# EasyEDA Pro project ProPrj_Avaota A1 八核 AIoT 开发板_2024-05-03.epro, board 点位_BOTTOM (continued)
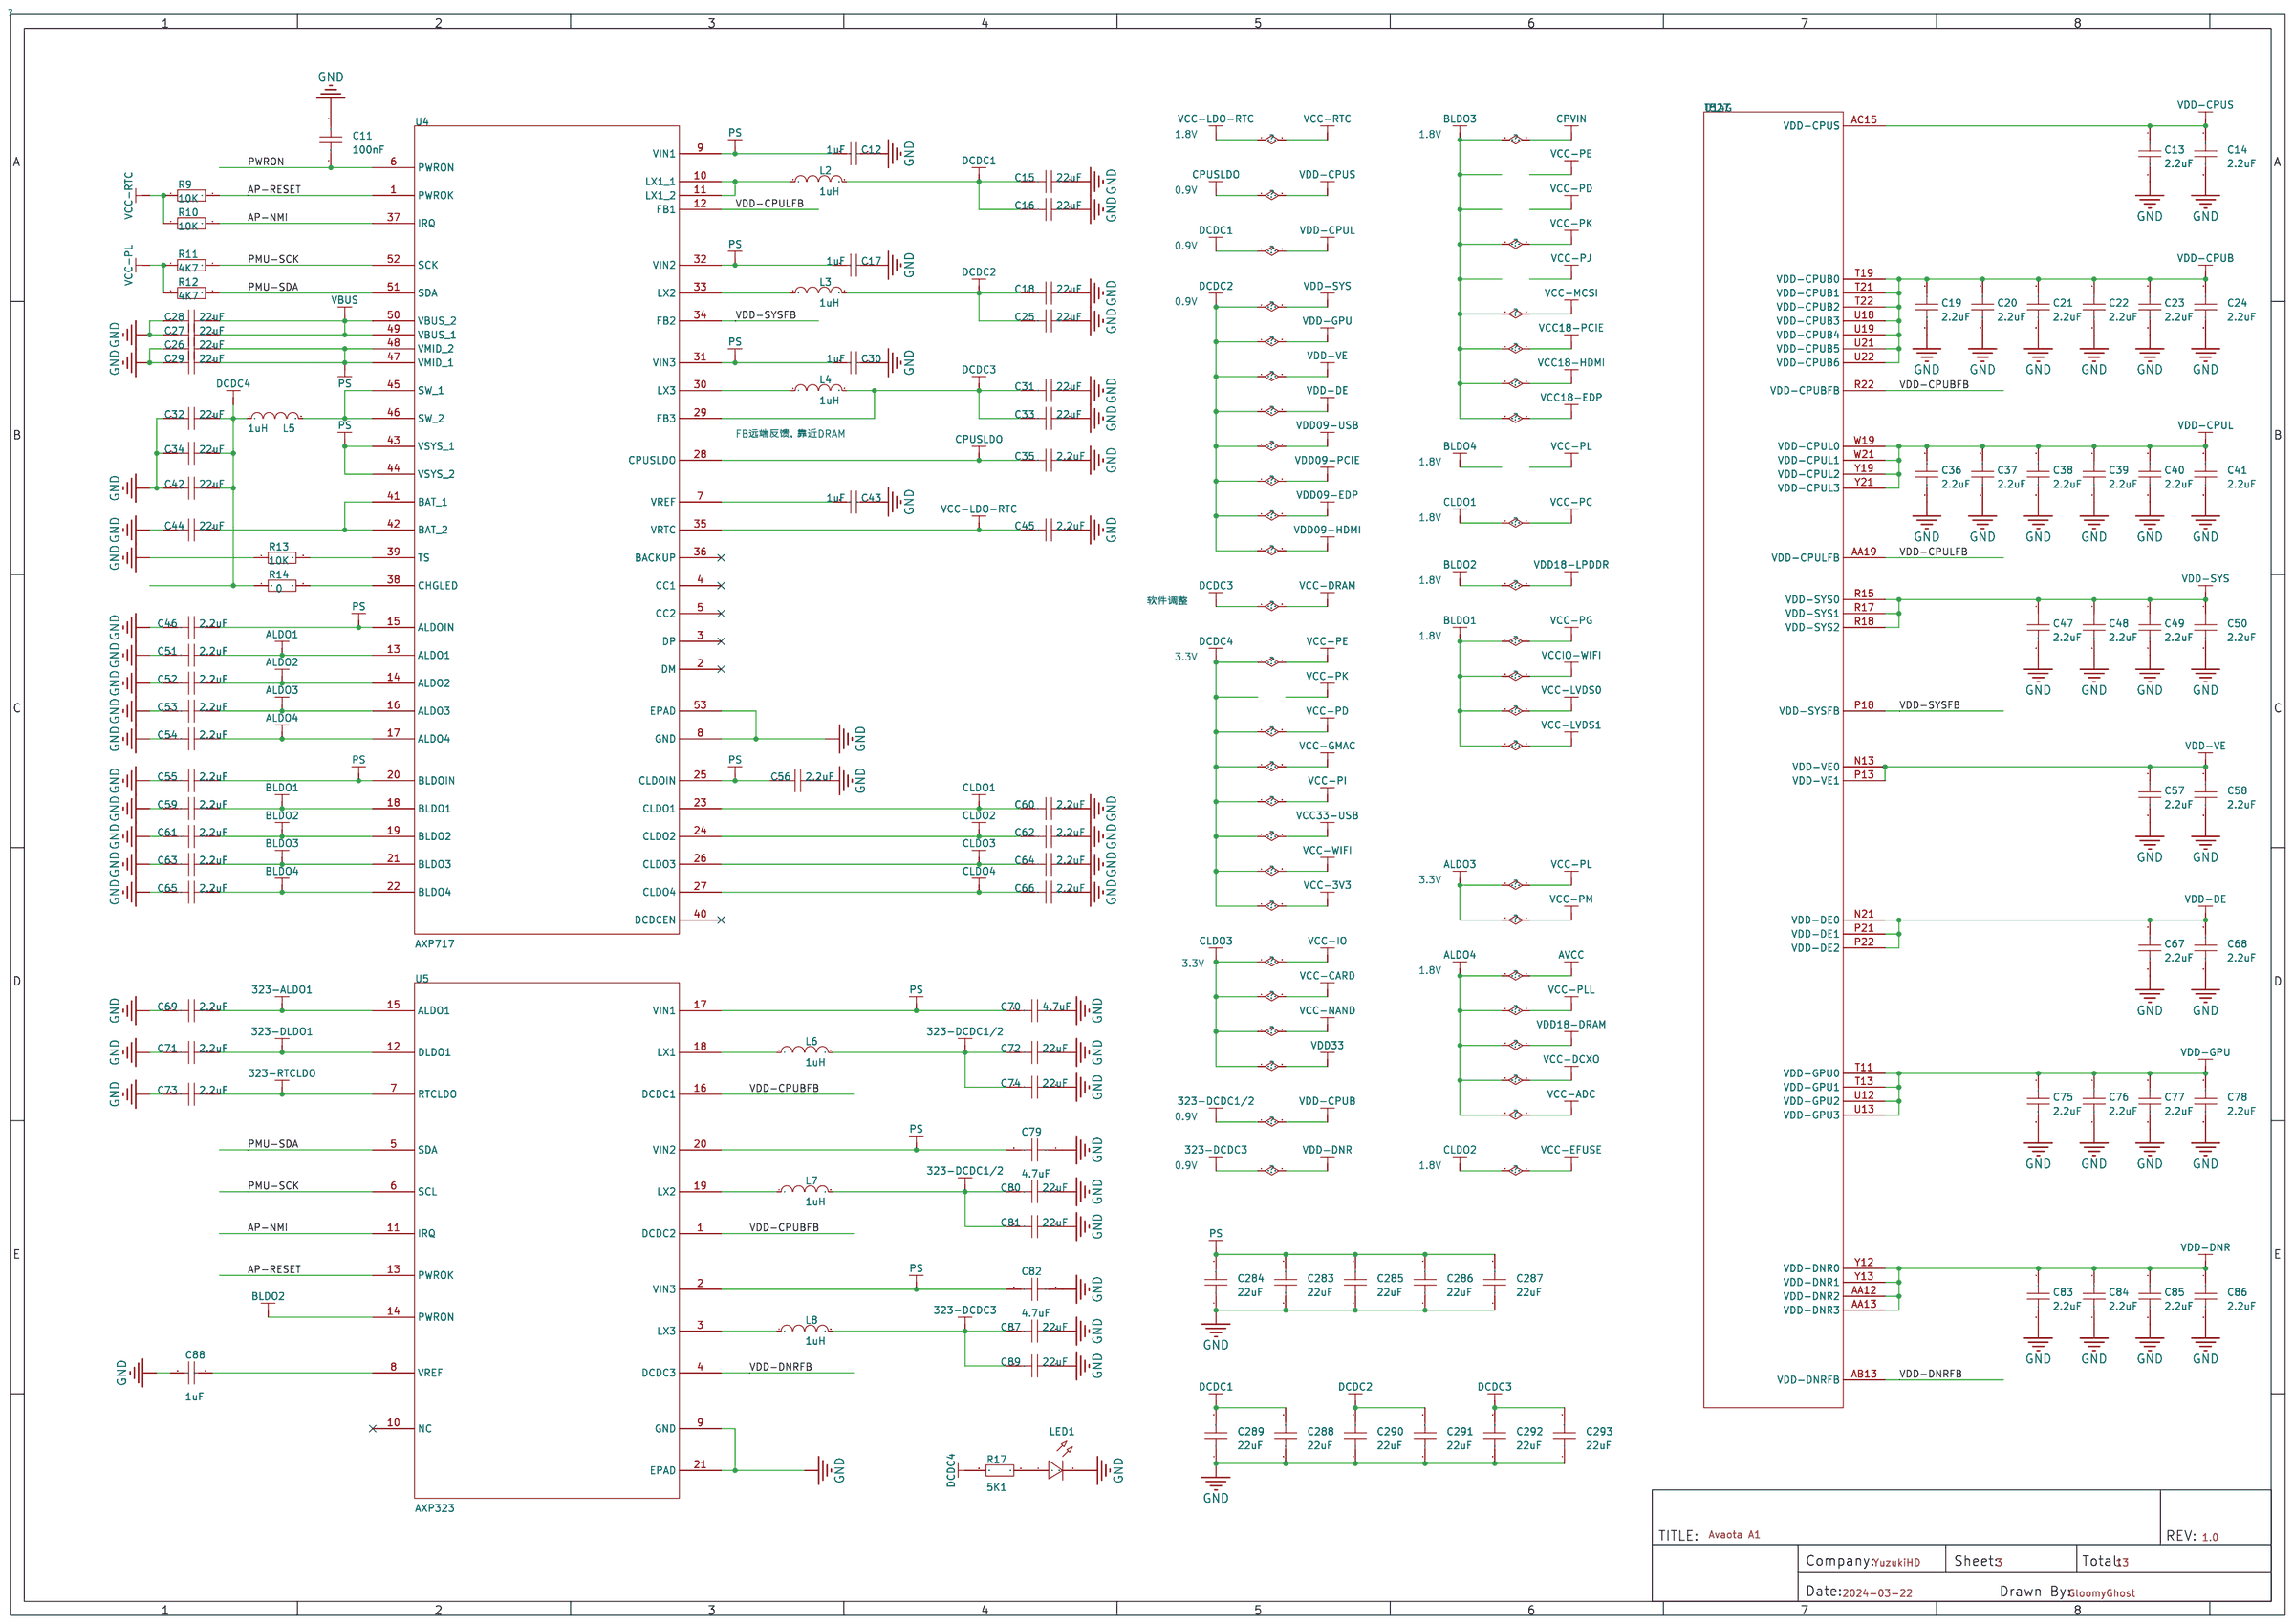
[diagram p0: POWER]
## Routing (per net, layer and track width the routed paths; a pad name or vN(x,y) marks a point on that pad's centre or on a via; arc(x,y) is an arc through that point) (continued)
SDQ22: length 9.9
  内层2 w0.115: v3(45.82,52.55) 45.43,52.16 45.43,51.31 49.66,47.08 49.94,47.08 51.38,45.63 v3(51.38,45.47)
SDQ23: length 17.3
  内层2 w0.115: v3(42.82,54.46) 45.72,54.46 51.59,48.59 51.97,48.59 54.4,46.15 56.12,46.15 v3(56.55,45.72)
SDQ24: length 24.8
  Inner5 w0.115: v3(56.54,46.68) 56.54,46.89 55.78,47.65 55.23,47.65 54.51,48.37 54.51,48.39 54.2,48.69 51.51,48.69 49.38,50.83 49.38,50.99 45.37,54.99 37.41,54.99 36.88,54.46 36.88,54.05 36.6,53.77 36.24,53.77 v3(36.17,53.7)
SDQ25: length 22
  Inner5 w0.115: v3(37.69,54.61) 38.07,54.23 38.81,54.23 39.04,54.46 40.36,54.46 40.73,54.09 45.68,54.09 48.96,50.81 48.96,50.58 51.13,48.41 53.87,48.41 55.01,47.27 55.52,47.27 56.01,46.79 v3(56.01,46.68)
SDQ26: length 26
  Inner5 w0.115: v3(34.57,51.71) 34.21,52.07 34.21,53.19 34.44,53.42 35.05,53.42 35.18,53.29 36.58,53.29 36.96,53.67 37.79,53.67 38.02,53.9 38.96,53.9 39.09,54.03 40.31,54.03 40.66,53.67 45.39,53.67 48.54,50.52 48.54,50.41 50.84,48.11 53.59,48.11 54.96,46.73 v3(54.96,46.68)
SDQ27: length 23.4
  Inner5 w0.115: v3(54.43,46.68) 53.77,47.35 51.01,47.35 46.95,51.41 46.56,51.41 46.3,51.66 46.3,51.79 46,52.1 45.62,52.1 44.49,53.23 41.95,53.23 41.81,53.37 40.46,53.37 40.1,53.72 39.22,53.72 39.11,53.62 38.07,53.62 37.82,53.37 37.54,53.37 37.41,53.24 37.41,52.98 37.26,52.83 34.77,52.83 v3(34.59,53.01)
SDQ28: length 11.9
  Inner5 w0.115: v3(37.64,50.75) 37.64,50.41 37.75,50.29 38.83,50.29 39.16,49.96 39.62,49.96 39.88,50.22 40.49,50.22 40.69,50.01 41.48,50.01 41.55,49.94 42.03,49.94 42.54,49.43 43.12,49.43 43.47,49.07 43.86,49.07 44.09,49.3 44.39,49.3 44.99,48.7 46.09,48.7 46.63,48.16 46.63,47.82 47.26,47.2 v3(47.27,47.2)
SDQ29: length 24
  Inner5 w0.115: v3(54.43,45.68) 53.96,45.68 53.76,45.88 52.59,45.88 52.18,46.29 48.19,46.29 47.78,46.71 47.14,46.71 45.57,48.29 44.3,48.29 43.93,48.65 43.3,48.65 42.95,49.01 42.45,49.01 41.91,49.56 41.43,49.56 41.25,49.73 40.59,49.73 40.36,49.96 40,49.96 39.78,49.73 39.04,49.73 38.81,49.5 36.68,49.5 36.5,49.33 34.3,49.33 34.19,49.44 34.19,50.57 v3(33.8,50.95)
SDQ30: length 19.7
  Inner5 w0.115: v3(38.48,52.55) 38.96,52.55 39.04,52.48 40.23,52.48 40.49,52.73 41.22,52.73 41.4,52.55 41.4,52.22 41.65,51.97 44.29,51.97 45.81,50.44 46.72,50.44 50.51,46.66 52.25,46.66 52.65,46.25 53.74,46.25 53.95,46.05 54.59,46.05 v3(54.96,45.68)
SDQ31: length 22.1
  Inner5 w0.115: v3(37.79,52.2) 37.79,52.43 38.28,52.91 38.9,52.91 39.01,53.02 39.01,53.11 39.29,53.39 39.85,53.39 40.18,53.06 41.53,53.06 41.78,52.81 44.04,52.81 45.89,50.95 46.81,50.95 50.75,47.02 53.49,47.02 54.23,46.28 55.5,46.28 56.01,45.77 v3(56.01,45.68)
SDQM0: length 17.6
  内层2 w0.115: v3(56.61,39) 56.6,39 56.6,38.95 55.87,38.22 43.49,38.22 41.68,40.03 41.68,40.41 40.89,41.2 v3(40.89,41.27)
SDQM1: length 22.5
  Inner5 w0.115: v3(37.89,41.94) 37.74,42.09 37.74,42.32 38.05,42.62 39.65,42.62 40.13,42.14 41.09,42.14 42.06,41.17 42.44,41.17 42.83,41.56 43.98,41.56 44.35,41.94 46.15,41.94 46.9,41.19 51.55,41.19 52.19,40.54 57.33,40.54 v3(57.94,41.15)
SDQM2: length 8
  内层2 w0.115: v3(44.14,51.54) 44.12,51.51 44.12,50.75 44.17,50.7 44.17,50.69 46.89,47.97 46.89,47.05 47.63,46.3 47.7,46.3 v3(48.54,45.47)
SDQM3: length 15.4
  Inner5 w0.115: v3(47.27,47.78) 47.01,48.03 47.01,48.29 46.17,49.12 45.16,49.12 44.43,49.85 42.65,49.85 42.31,50.19 42.31,50.39 41.96,50.75 40.66,50.75 40.49,50.57 39.77,50.57 39.62,50.72 38.81,50.72 38.43,51.1 37.44,51.1 37.16,50.83 35.66,50.83 35,51.49 35,51.94 v3(34.62,52.32)
SDQS0N: length 17.2
  内层2 w0.127: v3(55.54,39.03) 55.54,39.18 55.03,39.69 52.26,39.69 52.09,39.52 48.54,39.52 48.33,39.73 43.23,39.73 42.53,40.43 42.53,40.68 41.22,42 40.8,42 40.63,42.18 40.63,42.45 40.75,42.57 v3(40.93,42.57)
SDQS0P: length 16.7
  内层2 w0.127: v3(54.98,39.03) 54.61,39.4 52.38,39.4 52.21,39.23 48.42,39.23 48.21,39.44 43.11,39.44 42.24,40.31 42.24,40.56 41.1,41.71 40.68,41.71 40.33,42.06 40.33,42.5 v3(40.26,42.57)
SDQS1N: length 28.4
  Inner5 w0.127: v3(59.23,38.96) 59.18,38.91 59.18,38.59 58.88,38.3 36.17,38.3 35.01,39.46 35.01,41.97 34.8,42.19 34.8,42.47 34.69,42.57 v3(34.69,42.57)
SDQS1P: length 27.7
  Inner5 w0.127: v3(58.67,38.96) 58.76,38.96 58.89,38.84 58.89,38.72 58.76,38.59 36.29,38.59 35.3,39.58 35.3,42.09 35.09,42.31 35.09,42.44 35.22,42.57 v3(35.33,42.57)
SDQS2N: length 13.4
  内层2 w0.127: v3(49.66,45.47) 49.76,45.47 49.9,45.61 49.9,45.74 49.72,45.92 48.79,45.92 47.69,47.03 47.69,47.89 44.63,50.95 44.63,51.83 44.36,52.11 43.9,52.11 43.53,51.74 41.49,51.74 41.28,51.96 41.12,51.96 40.99,51.83 v3(40.99,51.76)
SDQS2P: length 13.6
  内层2 w0.127: v3(40.99,52.35) 41.09,52.25 41.4,52.25 41.62,52.03 43.41,52.03 43.78,52.4 44.48,52.4 44.92,51.96 44.92,51.07 47.98,48.01 47.98,47.15 48.91,46.21 49.84,46.21 50.19,45.87 50.19,45.52 v3(50.24,45.47)
SDQS3N: length 16.4
  Inner5 w0.127: v3(35.35,51.69) 35.35,51.82 35.48,51.94 35.68,51.94 35.92,51.7 37.22,51.7 37.38,51.54 38.05,51.54 38.38,51.87 39.8,51.87 40.56,51.1 42.01,51.1 42.47,50.65 44.4,50.65 45.41,49.63 46.41,49.63 47.65,48.4 47.65,47.55 48.14,47.05 48.58,47.05 48.73,46.9 v3(48.75,46.9)
SDQS3P: length 16.2
  Inner5 w0.127: v3(48.74,47.41) 48.67,47.35 48.26,47.35 47.94,47.67 47.94,48.52 46.54,49.92 45.53,49.92 44.52,50.94 42.56,50.94 42.1,51.4 40.68,51.4 39.92,52.16 38.26,52.16 37.93,51.83 37.5,51.83 37.34,51.99 36.04,51.99 35.8,52.23 35.55,52.23 v3(35.41,52.37)
SPI0-CLK: length 1
  Bottom Layer w0.102: 57.49,63.73 58.14,63.73 v2(58.42,63.45)
SPI0-CS: length 3.6
  Bottom Layer w0.102: v2(63.68,66.4) 65.42,66.4 ; 65.42,66.4 65.55,66.27 ; 65.42,66.4 65.09,66.73 R73.1
SPI0-HOLD: length 2.4
  Bottom Layer w0.102: v2(58.62,64.59) 58.22,65 57.49,65 57.47,65.01 R75.1
SPI0-MISO: length 7.3
  Bottom Layer w0.102: v2(63.73,64.47) 63.7,64.47 63.47,64.69 63.47,65.79 63.6,65.91 63.75,65.91 63.88,65.79 63.88,64.82 63.96,64.74 64.1,64.74 64.19,64.82 64.19,65.79 64.28,65.88 64.4,65.88 64.49,65.79 64.49,64.77 64.8,64.47 65.46,64.47 65.55,64.56 65.55,65
SPI0-MOSI: length 1.6
  Bottom Layer w0.102: v2(58.88,63.07) 58.27,62.46 57.49,62.46
SPI0-WP: length 7.5
  Bottom Layer w0.102: v2(64.24,63.75) 63.93,63.75 63.55,63.37 63.55,62.18 63.68,62.05 63.88,62.05 63.98,62.16 63.98,63.17 64.11,63.3 64.31,63.3 64.54,63.07 65.71,63.07 65.86,63.22 65.86,63.42 65.55,63.73 66.74,63.73 R74.1
SPI-LCD-BLK: length 91.2
  内层2 w0.127: v1(46.76,64.26) 46.91,64.26 47.19,64.54 47.19,65.35 49.05,67.21 53.39,67.21 58.29,62.31 62.13,62.31 63.2,63.37 64.59,63.37 64.87,63.65 89.56,63.65 92.91,60.3 v1(92.91,54.1)
  Bottom Layer w0.102: v1(52.45,52.78) 52.35,52.78 50.55,54.58 50.55,55.17 48.92,56.79 48.92,58.39 47.8,59.51 47.8,60.3 46.76,61.34 v1(46.76,64.26) 46.76,69.37 47.24,69.85 47.24,72.16 46.18,73.23 46,73.23
  Bottom Layer w0.127: U16.4 86.82,53.04 87.88,54.1 v1(92.91,54.1)
SPI-LCD-CLK: length 91.4
  内层2 w0.127: v1(47.75,63.47) 47.98,63.7 47.98,64.8 49.66,66.47 52.88,66.47 57.78,61.57 62.74,61.57 63.78,62.61 65.1,62.61 65.41,62.92 89.08,62.92 92,60 92,53.65 92.53,53.11 92.53,49.94 91.41,48.82 91.41,48.29 92.05,47.65 92.05,45.75 v1(92.07,45.72)
  Bottom Layer w0.102: v2(54.94,52.65) 54.53,53.06 54.25,53.06 54.18,52.98 53.26,52.98 52.68,53.57 52.53,53.57 51.18,54.92 51.18,55.52 49.58,57.12 49.58,58.67 48.41,59.84 48.41,60.78 47.75,61.44 v1(47.75,63.47) 47.75,68.71 48.34,69.29 48.92,69.29 49.89,70.26 49.89,71.88 51.08,73.08 51.08,73.23
SPI-LCD-CS: length 90.2
  内层2 w0.127: v1(90.91,45.29) 91.14,45.52 91.57,45.52 91.9,45.19 92.18,45.19 92.46,45.47 92.46,49.17 92.91,49.63 92.91,53.29 92.46,53.75 92.46,60.17 89.36,63.27 65.13,63.27 64.85,62.99 63.45,62.99 62.38,61.93 58.01,61.93 53.14,66.8 49.4,66.8 47.57,64.97 47.57,64.11 47.32,63.86 v1(47.24,63.86)
  Bottom Layer w0.102: 48.54,70.69 48.54,70.36 47.24,69.06 v1(47.24,63.86) 47.24,61.39 48.11,60.53 48.11,59.66 49.25,58.52 49.25,57 50.88,55.37 50.88,54.76 52.48,53.16 52.65,53.16 53.16,52.65 v2(54.43,52.65)
SPI-LCD-DC: length 89.3
  内层2 w0.127: v1(91.57,46.18) 91.57,46.48 90.58,47.47 90.58,49.33 91.77,50.52 91.77,52.48 91.03,53.21 91.03,59.77 88.62,62.18 65.81,62.18 65.46,61.82 64.29,61.82 63.32,60.86 57.51,60.86 52.58,65.79 50.09,65.79 48.72,64.41 v1(48.72,62.69)
  Bottom Layer w0.076: 53.52,53.67 54,53.67 54.28,53.95 54.64,53.95 v2(54.97,53.62)
  Bottom Layer w0.102: 53.52,53.67 51.82,55.37 51.82,55.93 50.29,57.46 50.29,58.9 49.05,60.15 49.05,61.21 48.72,61.54 v1(48.72,62.69) 48.72,68.07 49,68.35 49.48,68.35 50.52,69.39 51.84,69.39 52.43,69.98 52.43,72.06 52.88,72.52 52.91,72.52 53.62,73.23
SPI-LCD-MOSI: length 85.3
  内层2 w0.127: v1(48.21,63.07) 48.34,63.2 48.34,64.57 49.89,66.12 52.73,66.12 57.66,61.19 63.04,61.19 64.11,62.26 65.3,62.26 65.61,62.56 88.85,62.56 91.49,59.92 91.49,53.47 92.18,52.78 92.18,50.27 91.01,49.1 91.01,47.7 v1(91.62,47.09)
  Bottom Layer w0.102: v2(54.46,53.62) 54.1,53.26 53.49,53.26 52.81,53.95 52.65,53.95 51.49,55.12 51.49,55.73 49.94,57.28 49.94,58.8 48.72,60.02 48.72,61.06 48.21,61.57 v1(48.21,63.07) 48.21,68.43 48.64,68.86 49.23,68.86 51.05,70.69 51.08,70.69
SPI-LCD-RST: length 90.7
  内层2 w0.127: v1(46.35,64.74) 46.35,65.05 48.89,67.59 53.59,67.59 58.55,62.64 61.77,62.64 62.99,63.86 63.75,63.86 64.06,64.16 64.67,64.16 64.77,64.06 89.71,64.06 93.37,60.4 93.37,47.75 92.86,47.24 92.86,45.21 92.35,44.7 91.67,44.7 v1(91.52,44.86)
  Bottom Layer w0.102: 46,70.69 46.35,70.33 v1(46.35,64.74) 46.35,61.24 47.55,60.05 47.55,59.36 48.62,58.29 48.62,56.72 50.24,55.09 50.24,54.46 v2(52.45,52.25)
SRST: length 26.8
  内层2 w0.115: v3(34.63,50.27) 35.27,50.9 36.75,50.9 37.36,50.29 38.45,50.29 38.89,50.72 39.85,50.72 40,50.57 40.46,50.57 40.71,50.83 41.93,50.83 42.24,50.52 42.24,50.29 44.22,48.31 44.77,48.31 45.59,47.49 45.59,47.02 45.31,46.74 45.31,46.33 45.54,46.1 45.97,46.1 47.22,44.86 52.17,44.86 52.7,44.32 56.22,44.32 v3(56.56,44.66)
STWI1-SCK: length 18.2
  Bottom Layer w0.102: 41.92,72.21 42.24,71.88 42.24,70.13 43.18,69.19 43.18,67.06 45.54,64.69 45.54,60.88 46.76,59.66 46.76,57.58 v1(46.86,57.48) ; 41.92,72.21 40.91,73.22 ; 41.92,72.21 41.92,72.23
STWI1-SDA: length 14.5
  Bottom Layer w0.102: 43.46,70.69 43.51,70.64 43.51,67.16 45.9,64.77 45.9,61.06 47.19,59.77 47.19,57.96 v1(47.32,57.84)
UART1-CTS: length 48.8
  Inner5 w0.102: v2(19.66,61.21) 21.84,63.4 45.26,63.4 49.2,59.46 55.25,59.46 56.59,58.12 58.17,58.12 61.04,55.25 62.2,55.25 62.56,54.89 62.56,54.26 v2(61.95,53.65)
UART1-RTS: length 48.9
  Inner5 w0.102: v2(19.05,61.24) 21.54,63.73 45.34,63.73 49.3,59.77 55.32,59.77 56.69,58.39 58.32,58.39 61.19,55.52 62.36,55.52 62.95,54.93 v2(62.95,54.65)
UART1-RX: length 50.8
  Inner5 w0.102: v2(62.95,54.15) 63.3,54.49 63.3,55.09 62.59,55.8 61.32,55.8 58.45,58.67 56.82,58.67 55.35,60.15 49.35,60.15 45.44,64.06 21.26,64.06 v2(18.49,61.29)
UART1-TX: length 52.6
  Inner5 w0.102: v2(17.91,61.32) 20.98,64.39 45.54,64.39 49.5,60.43 55.52,60.43 57.02,58.93 58.6,58.93 61.42,56.11 62.71,56.11 63.6,55.22 63.6,54.3 v2(62.95,53.65)
USB0-DM: length 25.9
  VCC w0.127: v2(75.23,44.45) 75.23,44.79 75.37,44.93 75.37,46.84 81.36,52.83 81.36,59.44 85.55,63.63 85.55,64.85 v2(85.37,65.02)
  Bottom Layer w0.127: v2(86.33,67.51) 86.31,67.49 v2(85.34,67.49)
USB0-DP: length 24.8
  VCC w0.127: v2(75.74,44.53) 75.74,44.79 75.6,44.93 75.6,46.7 81.64,52.73 81.64,59.36 85.78,63.5 85.78,64.85 v2(85.95,65.02)
USB0-DRVVBUS: length 84.5
  内层2 w0.102: v1(56.92,46.99) 55.98,47.93 54.74,47.93 54.41,48.26 53.9,48.26 52.12,50.04 51.31,50.04 50.9,50.44 50.9,53.95 49.3,55.55 46.53,55.55 45.62,56.46 45.01,56.46 44.63,56.85 44.35,56.85 v1(43.56,57.63)
  内层4 w0.152: v1(42.09,64.9) 44.58,67.39 64.26,67.39 67.01,64.64 87.78,64.64 91.16,68.02 91.64,68.02 91.95,67.72 91.95,66.5 v1(93.32,65.13)
  Bottom Layer w0.102: v1(42.09,64.9) 43,63.98 43,59.11 43.69,58.42 43.69,57.76 v1(43.56,57.63)
USB0-VBUSDET: length 78.9
  内层2 w0.102: v1(56.92,47.57) 56.26,48.23 54.86,48.23 54.56,48.54 53.97,48.54 52.22,50.29 51.46,50.29 51.18,50.57 51.18,54.15 49.5,55.83 46.74,55.83 45.72,56.85 45.16,56.85 44.78,57.23 44.63,57.23 v1(44.15,57.71)
  内层4 w0.152: v1(42.67,64.9) 44.7,66.93 64.01,66.93 66.7,64.24 87.99,64.24 v2(91.36,67.62)
  Bottom Layer w0.102: v1(44.15,57.71) 43.97,57.89 43.97,58.6 43.31,59.26 43.31,64.26 v1(42.67,64.9)
USB1-DM: length 75.3
  Bottom Layer w0.127: v2(32.54,17.15) 32.41,17.02 32.41,15.11 31.85,14.55 28.11,14.55 26.71,15.96 26.71,19.82 35.03,28.14 44,28.14 47.02,31.17 66.52,31.17 71.32,35.97 71.32,42.62 69.9,44.04 69.15,44.04 68.39,44.8 67.79,44.8 v2(67.44,45.15)
USB1-DP: length 75.8
  Bottom Layer w0.127: v2(67.94,45.15) 68.21,45.15 68.33,45.03 68.49,45.03 69.24,44.27 69.96,44.27 71.53,42.71 71.53,35.85 66.64,30.96 47.14,30.96 44.09,27.91 35.13,27.91 26.94,19.72 26.94,16.05 28.18,14.81 31.75,14.81 32.18,15.24 32.18,15.47 32.06,15.6 31.79,15.6 31.66,15.73 31.66,15.86 31.79,15.98 32.06,15.98 32.18,16.11 32.18,16.24 32.06,16.36 31.79,16.36 31.66,16.49 31.66,16.62 31.79,16.74 32.06,16.74 32.18,16.87 32.18,16.99 v2(32.03,17.15)
USB2-DM: length 84.2
  Bottom Layer w0.127: v2(27.69,18.03) 27.86,18.21 27.86,19.37 28.1,19.61 28.1,19.79 28.28,19.97 28.46,19.97 28.64,20.15 28.64,20.33 28.82,20.51 29,20.51 29.18,20.69 29.18,20.87 29.36,21.05 29.54,21.05 29.72,21.23 29.72,21.41 29.9,21.59 30.08,21.59 30.26,21.77 30.26,21.95 30.44,22.13 30.62,22.13 30.8,22.31 30.8,22.49 30.98,22.67 31.16,22.67 31.34,22.85 31.34,23.03 31.52,23.21 31.7,23.21 31.88,23.39 31.88,23.57 32.06,23.75 32.24,23.75 32.41,23.92 32.41,24.1 32.59,24.28 32.77,24.28 32.95,24.46 32.95,24.64 33.13,24.82 33.31,24.82 33.49,25 33.49,25.18 33.67,25.36 33.85,25.36 34.03,25.54 34.03,25.72 34.21,25.9 34.39,25.9 35.52,27.03 44.38,27.03 47.76,30.4 75.23,30.4 76.25,31.42 76.25,32.7 74.02,34.93 74.02,37.8 71.98,39.83 71.98,42.75 70.13,44.6 69.59,44.6 68.39,45.8 67.79,45.8 v2(67.44,46.15) ; 28.03,10.44 28.73,10.44 28.93,10.24 28.93,10.03 28.63,9.73 27.32,9.73 26.97,10.09 26.97,10.68 26.14,11.51 26.14,12.54 25.52,13.16 24.84,13.16 24.27,13.73 24.27,13.8 24.41,13.94 v2(24.41,14.2)
USB2-DP: length 83.5
  Bottom Layer w0.127: v2(23.9,14.2) 23.9,13.94 24.04,13.8 24.04,13.64 24.75,12.93 25.43,12.93 25.91,12.45 25.91,11.41 26.74,10.58 26.74,9.99 27.23,9.5 28.72,9.5 29.16,9.94 29.16,10.24 29.41,10.49 29.98,10.49 30.03,10.44 ; v2(67.94,46.15) 68.21,46.15 68.33,46.03 68.49,46.03 69.69,44.83 70.22,44.83 72.21,42.84 72.21,39.93 74.24,37.9 74.24,35.03 76.48,32.79 76.48,31.33 75.35,30.2 47.88,30.2 44.48,26.8 35.61,26.8 28.09,19.28 28.09,18.29 v2(28.35,18.03)
USB2-RXN: length 73.4
  Bottom Layer w0.127: v2(72.31,45.47) 72.31,45.2 72.26,45.15 72.26,45.09 73.71,43.64 73.71,40.95 74.98,39.68 76.52,39.68 79.5,36.7 79.5,31.55 76.45,28.5 49.19,28.5 45.46,24.77 36.96,24.77 30.99,18.8 30.99,17.32 v2(31.17,17.15)
USB2-RXP: length 74.4
  Bottom Layer w0.127: v2(71.83,45.62) 71.83,45.23 73.48,43.58 73.48,40.85 74.89,39.45 76.43,39.45 79.27,36.6 79.27,31.65 76.35,28.73 49.1,28.73 45.36,24.99 36.86,24.99 30.78,18.92 30.78,18.3 30.66,18.17 30.33,18.17 30.2,18.04 30.2,17.92 30.33,17.79 30.66,17.79 30.78,17.66 30.78,17.3 v2(30.63,17.15)
USB2-TXN: length 73.2
  Bottom Layer w0.127: v2(71.3,46.05) 71.3,45.76 71.16,45.62 71.16,44.84 72.87,43.13 72.87,40.46 74.57,38.76 76.24,38.76 78.56,36.44 78.56,32.11 75.74,29.29 48.44,29.29 44.81,25.66 36.3,25.66 29.49,18.85 29.49,18.44 v2(29.64,18.29)
USB2-TXP: length 74.5
  Bottom Layer w0.127: v2(29.13,18.29) 29.26,18.42 29.26,18.95 29.49,19.18 29.49,19.46 29.62,19.59 29.9,19.59 30.03,19.72 30.03,19.99 30.16,20.12 30.44,20.12 30.57,20.25 30.57,20.53 30.7,20.66 30.97,20.66 31.1,20.79 31.1,21.07 31.23,21.2 31.51,21.2 31.64,21.33 31.64,21.61 31.77,21.74 32.05,21.74 32.18,21.87 32.18,22.15 32.31,22.28 32.59,22.28 32.72,22.41 32.72,22.69 32.85,22.82 33.13,22.82 33.26,22.95 33.26,23.23 33.39,23.36 33.67,23.36 36.2,25.89 44.72,25.89 48.37,29.54 75.67,29.54 78.33,32.21 78.33,36.35 76.15,38.53 74.48,38.53 72.64,40.37 72.64,43.03 70.93,44.74 70.93,45.62 70.79,45.76 v2(70.79,46.03)
VCM-ADC: length 0.6
  Bottom Layer w0.203: v1(59.94,52.15) 59.94,52.22 59.72,52.45 59.72,52.63 C112.2
VRA1: length 0.5
  Bottom Layer w0.152: v2(56.92,54.15) 57.36,54.15 C109.2
VRA2: length 0.5
  Bottom Layer w0.152: C110.2 57.42,54.65 v2(56.92,54.65)
VREFP-ADC: length 1.3
  Bottom Layer w0.102: v2(59.44,52.15) 59.37,52.08 R24.1
  Bottom Layer w0.203: v2(59.44,52.15) 59.44,52.19 C113.2
VRP: length 1
  Bottom Layer w0.178: C111.2 58.52,53.22 v2(58.44,53.15)
WL-REG-ON: length 1
  Bottom Layer w0.102: v2(18.44,53.77) v2(17.48,53.77)
$3N7591: length 0.8
  Bottom Layer w0.152: 59.38,42.56 59.41,42.53 59.41,42.29 59.58,42.12 v3(59.9,42.12)
$3N7643: length 0.9
  Bottom Layer w0.115: 39.27,39.45 38.98,39.45 38.71,39.73 v3(38.71,39.98)
$3N7644: length 0.7
  Bottom Layer w0.115: v3(36.52,39.78) 36.43,39.87 36.43,40.45
$6N1044: length 0.5
  Bottom Layer w0.152: R44.2 66.44,45.69 v2(66.44,46.15)
$6N1104: length 0.5
  Bottom Layer w0.152: R46.2 66.43,45.14 v2(66.44,45.15)
$6N1424: length 0.6
  Bottom Layer w0.254: v2(66.94,43.15) 66.62,43.47 R55.2
$6N1887: length 2.7
  Bottom Layer w0.102: v2(66.44,47.18) 66.89,47.18 67.26,47.55 68.12,47.55 68.33,47.35 R45.1
$6N1980: length 1.9
  Bottom Layer w0.102: v2(67.44,47.18) 67.44,47.04 67.72,46.76 67.97,46.76 68.17,46.56 68.8,46.56 R49.2
$6N3980: length 8.7
  Bottom Layer w0.102: v2(41.61,18.82) 41.88,19.1 42.52,19.1 44.83,16.79 44.83,14.96 44.27,14.4 44.27,13.67 43.54,12.94
$6N4341: length 6.2
  Bottom Layer w0.102: 43.54,14.09 44.53,15.08 44.53,16.61 42.44,18.69 v2(42.09,18.69)
$6N6451: length 10.7
  Bottom Layer w0.127: 53.89,18.08 53.89,17.92 52.76,16.79 51.94,16.79 51.66,16.51 51.66,16.08 51.51,15.93 50.29,15.93 49.53,16.69 49.53,21 49.68,21.15 v2(49.68,21.41)
$6N6466: length 10.6
  Bottom Layer w0.127: 53.89,16.78 53.89,16.65 52.7,15.47 51.79,15.47 51.56,15.7 50.2,15.7 49.28,16.62 49.28,21.02 49.15,21.15 v2(49.15,21.41)
$6N6553: length 1.2
  Bottom Layer w0.102: 52.39,14.83 52.38,14.82 R57.2
$6N6556: length 3.4
  Bottom Layer w0.102: 53.89,15.48 53.89,15.3 52.78,14.2 51.26,14.2 R56.2
$8N2040: length 3.5
  Bottom Layer w0.102: 92.81,52.88 92.81,52.05 D16.1 91.4,50.83 90.68,50.83
$8N9148: length 1.8
  Bottom Layer w0.102: 86.82,47.76 86.79,47.73 R116.1 R115.2
$8N11462: length 1.3
  Bottom Layer w0.254: R126.1 88.77,45.52 v1(90.02,45.52)
$10N1043: length 3.1
  Bottom Layer w0.508: 61.35,15.35 60.56,16.15 C248.2
$11N1789: length 3.3
  Bottom Layer w0.508: 79.61,15.33 78.85,16.1 C255.2
$13N1231: length 1.3
  Bottom Layer w0.102: R76.1 94.27,19.05 94.56,19.05 95.02,18.59 U11.8
$13N1478: length 3.3
  Bottom Layer w0.254: 96.29,18.32 96.29,18.87 97,19.58 97,20.29 v1(96.27,21.03)
$13N1485: length 3.3
  Bottom Layer w0.254: v1(96.8,21.34) 97.56,20.57 U11.6
$13N1600: length 0.5
  Bottom Layer w0.127: 70.5,68.57 70.49,68.58 70.49,69.09
$13N1603: length 0.5
  Bottom Layer w0.127: R66.1 C241.2
$13N2020: length 0.7
  Bottom Layer w0.254: 67.12,68.68 67.02,68.57 R67.2
$13N2077: length 0.7
  Bottom Layer w0.254: R68.2 67.02,69.66 C243.2

## Copper pours and planes (outline as drawn; the poured copper is in the pictures)
GND on Bottom Layer: -7.04,79.76 108.74,79.76 108.74,-11.68 -7.04,-11.68
GND on GND1: -8.17,81.08 107.6,81.08 107.6,-10.36 -8.17,-10.36
GND on GND1: 60.53,45.47 59.1,45.47 58.8,45.77 58.8,48.21 57.99,49.02 51.81,49.02 45.36,55.47 32.43,55.47 31.93,54.97 31.93,39.5 34.87,36.55 59.15,36.55 60.81,38.2 60.81,45.19
GND on GND1: 60.53,45.49 59.1,45.49 58.8,45.8 58.8,48.24 57.98,49.05 51.81,49.05 45.36,55.5 32.43,55.5 31.92,54.99 31.92,39.52 34.87,36.58 59.15,36.58 60.8,38.23 60.8,45.21
GND on 内层2: -7.99,80.77 107.79,80.77 107.79,-10.67 -7.99,-10.67
GND on VCC: 60.54,45.48 59.12,45.48 58.81,45.78 58.81,48.22 58,49.03 51.83,49.03 45.38,55.49 32.45,55.49 31.94,54.98 31.94,39.51 34.88,36.56 59.17,36.56 60.82,38.21 60.82,45.2
GND on VCC: -7.85,80.62 107.92,80.62 107.92,-10.82 -7.85,-10.82
GND on 内层4: -7.65,80.39 108.13,80.39 108.13,-11.05 -7.65,-11.05
GND on Inner5: -7.48,80.2 108.29,80.2 108.29,-11.24 -7.48,-11.24
GND on GND2: 60.51,45.48 59.09,45.48 58.79,45.78 58.79,48.22 57.97,49.03 51.8,49.03 45.35,55.49 32.42,55.49 31.91,54.98 31.91,39.51 34.86,36.56 59.14,36.56 60.79,38.21 60.79,45.2
GND on GND2: -7.29,80.01 108.48,80.01 108.48,-11.43 -7.29,-11.43
323-DCDC1/2 on 内层2: 59.33,48.43 59.33,45.81 59.95,45.19 62.33,45.19 62.69,45.54 62.69,50.4 52.53,60.55 32.16,60.55 27.2,55.6 27.2,52.68 20.5,45.97 20.5,41.22 21.77,39.95 23.22,39.95 25.32,42.06 25.32,44.7 31.27,50.65 31.27,54.28 32.92,55.93 47.62,55.93 54.58,48.97 58.79,48.97
323-DCDC3 on VCC: 60.81,50.9 60.81,49.91 60.3,49.4 57.51,49.4 57.48,49.43 52.22,49.43 45.82,55.83 31.75,55.83 22.22,46.3 18.03,46.3 16.71,47.61 16.71,49.15 18.97,51.41 21.72,51.41 30.4,60.1 47.65,60.1 55.6,52.15 59.56,52.15
BLDO2 on Bottom Layer: 43.23,38.99 44.66,40.42 44.66,53.91 43.31,55.27 33.34,55.27 32.02,53.96 32.02,40.14 33.17,38.99
DCDC1 on Bottom Layer: 10.85,47.95 12.75,47.95 12.75,45.75 10.85,45.75
DCDC1 on Inner5: 61.16,47.52 61.16,46.23 60.76,45.82 59.77,45.82 58.93,46.66 58.93,48.01 57.34,49.6 52.61,49.6 46.2,56.01 32.61,56.01 25.7,49.1 17.98,49.1 13.59,44.7 11.31,44.7 10.19,45.82 10.19,48.49 15.07,53.37 22.1,53.37 29.84,61.11 45.62,61.11 48.41,58.32 52.04,58.32 61.14,49.22 61.14,47.55
DCDC2 on 内层4: 58.52,49.57 58.52,49.61 52.04,49.61 45.54,56.11 19.99,56.11 16.81,59.28 14.5,59.28 13.87,59.92 10.44,59.92 9.22,58.7 9.22,57.53 8.79,57.1 6.02,57.1 5.36,57.76 5.36,60.45 7.67,62.76 20.43,62.76 22.82,60.38 54.08,60.38 65.23,49.23 65.81,49.23 66.12,48.92 66.12,48.01 63.73,45.62 63.09,45.62 62.81,45.9 62.28,45.9 62.03,46.15 62.03,47.21 61.77,47.47 60.62,47.47
DCDC3 on 内层4: 10.38,57.89 10.38,55.3 10.84,54.84 12.85,54.84 14.94,52.76 14.94,51.87 17.6,49.2 32.23,49.2 33.98,50.95 33.98,55.4 19.58,55.4 16.56,58.42 14.25,58.42 13.44,59.23 11.72,59.23
DCDC3 on 内层4: 60.52,45.45 59.1,45.45 58.79,45.76 58.79,48.2 58.29,48.7 51.94,48.7 45.23,55.41 32.38,55.41 31.92,54.95 31.92,39.48 34.87,36.54 59.15,36.54 60.8,38.19 60.8,45.17
GM1_DVDDRG on Bottom Layer: 3.28,54.13 5.92,54.13 5.92,52.76 3.28,52.76
GM1_DVDDRG on VCC: 2.69,54.23 4.79,54.23 4.79,52.22 2.69,52.22
PS on 内层2: 6.71,55.99 13.01,55.99 14.76,54.25 14.76,49.1 19.25,44.6 19.25,41.15 18.44,40.34 15.19,40.34 10.21,45.31 5.21,45.31 3.15,47.37 3.15,54.64 4.23,55.72 6.43,55.72

Small or netless copper shapes (teardrops, artwork), in the pictures only: 844 on Bottom Layer, 220 on 内层2, 58 on VCC, 66 on 内层4, 158 on Inner5, 10 on GND2

## Text on the board
Bottom Silkscreen Layer: BIOS | v1.3 | RGB888/LVDS/MIPI DSI/JTAG / UART/IIC/I2S/SPI/PWM  MUX | TFCard/JTAG | OV13850 | Avaota A1
